# Altium schematic sheet Cpcis_connectors_P1_P2_P3.SchDoc: STM32 System Board
size 420 x 297 mm; CheckedBy: P. Kulik, G. Daniluk; CompanyName: Creotech Instruments SA; DrawnBy: G.Kasprowicz; DocumentNumber: 5; SheetNumber: 5; CreateDate: 1.10.2019; CheckedDate: 10.11.2019; Title2: CPCIS Connectors P1-P3; Designer: G.Kasprowicz; DocumentName: AFPGA_power.SchDoc; ModifiedDate: -; Rule: PcbType=ProtelPcb
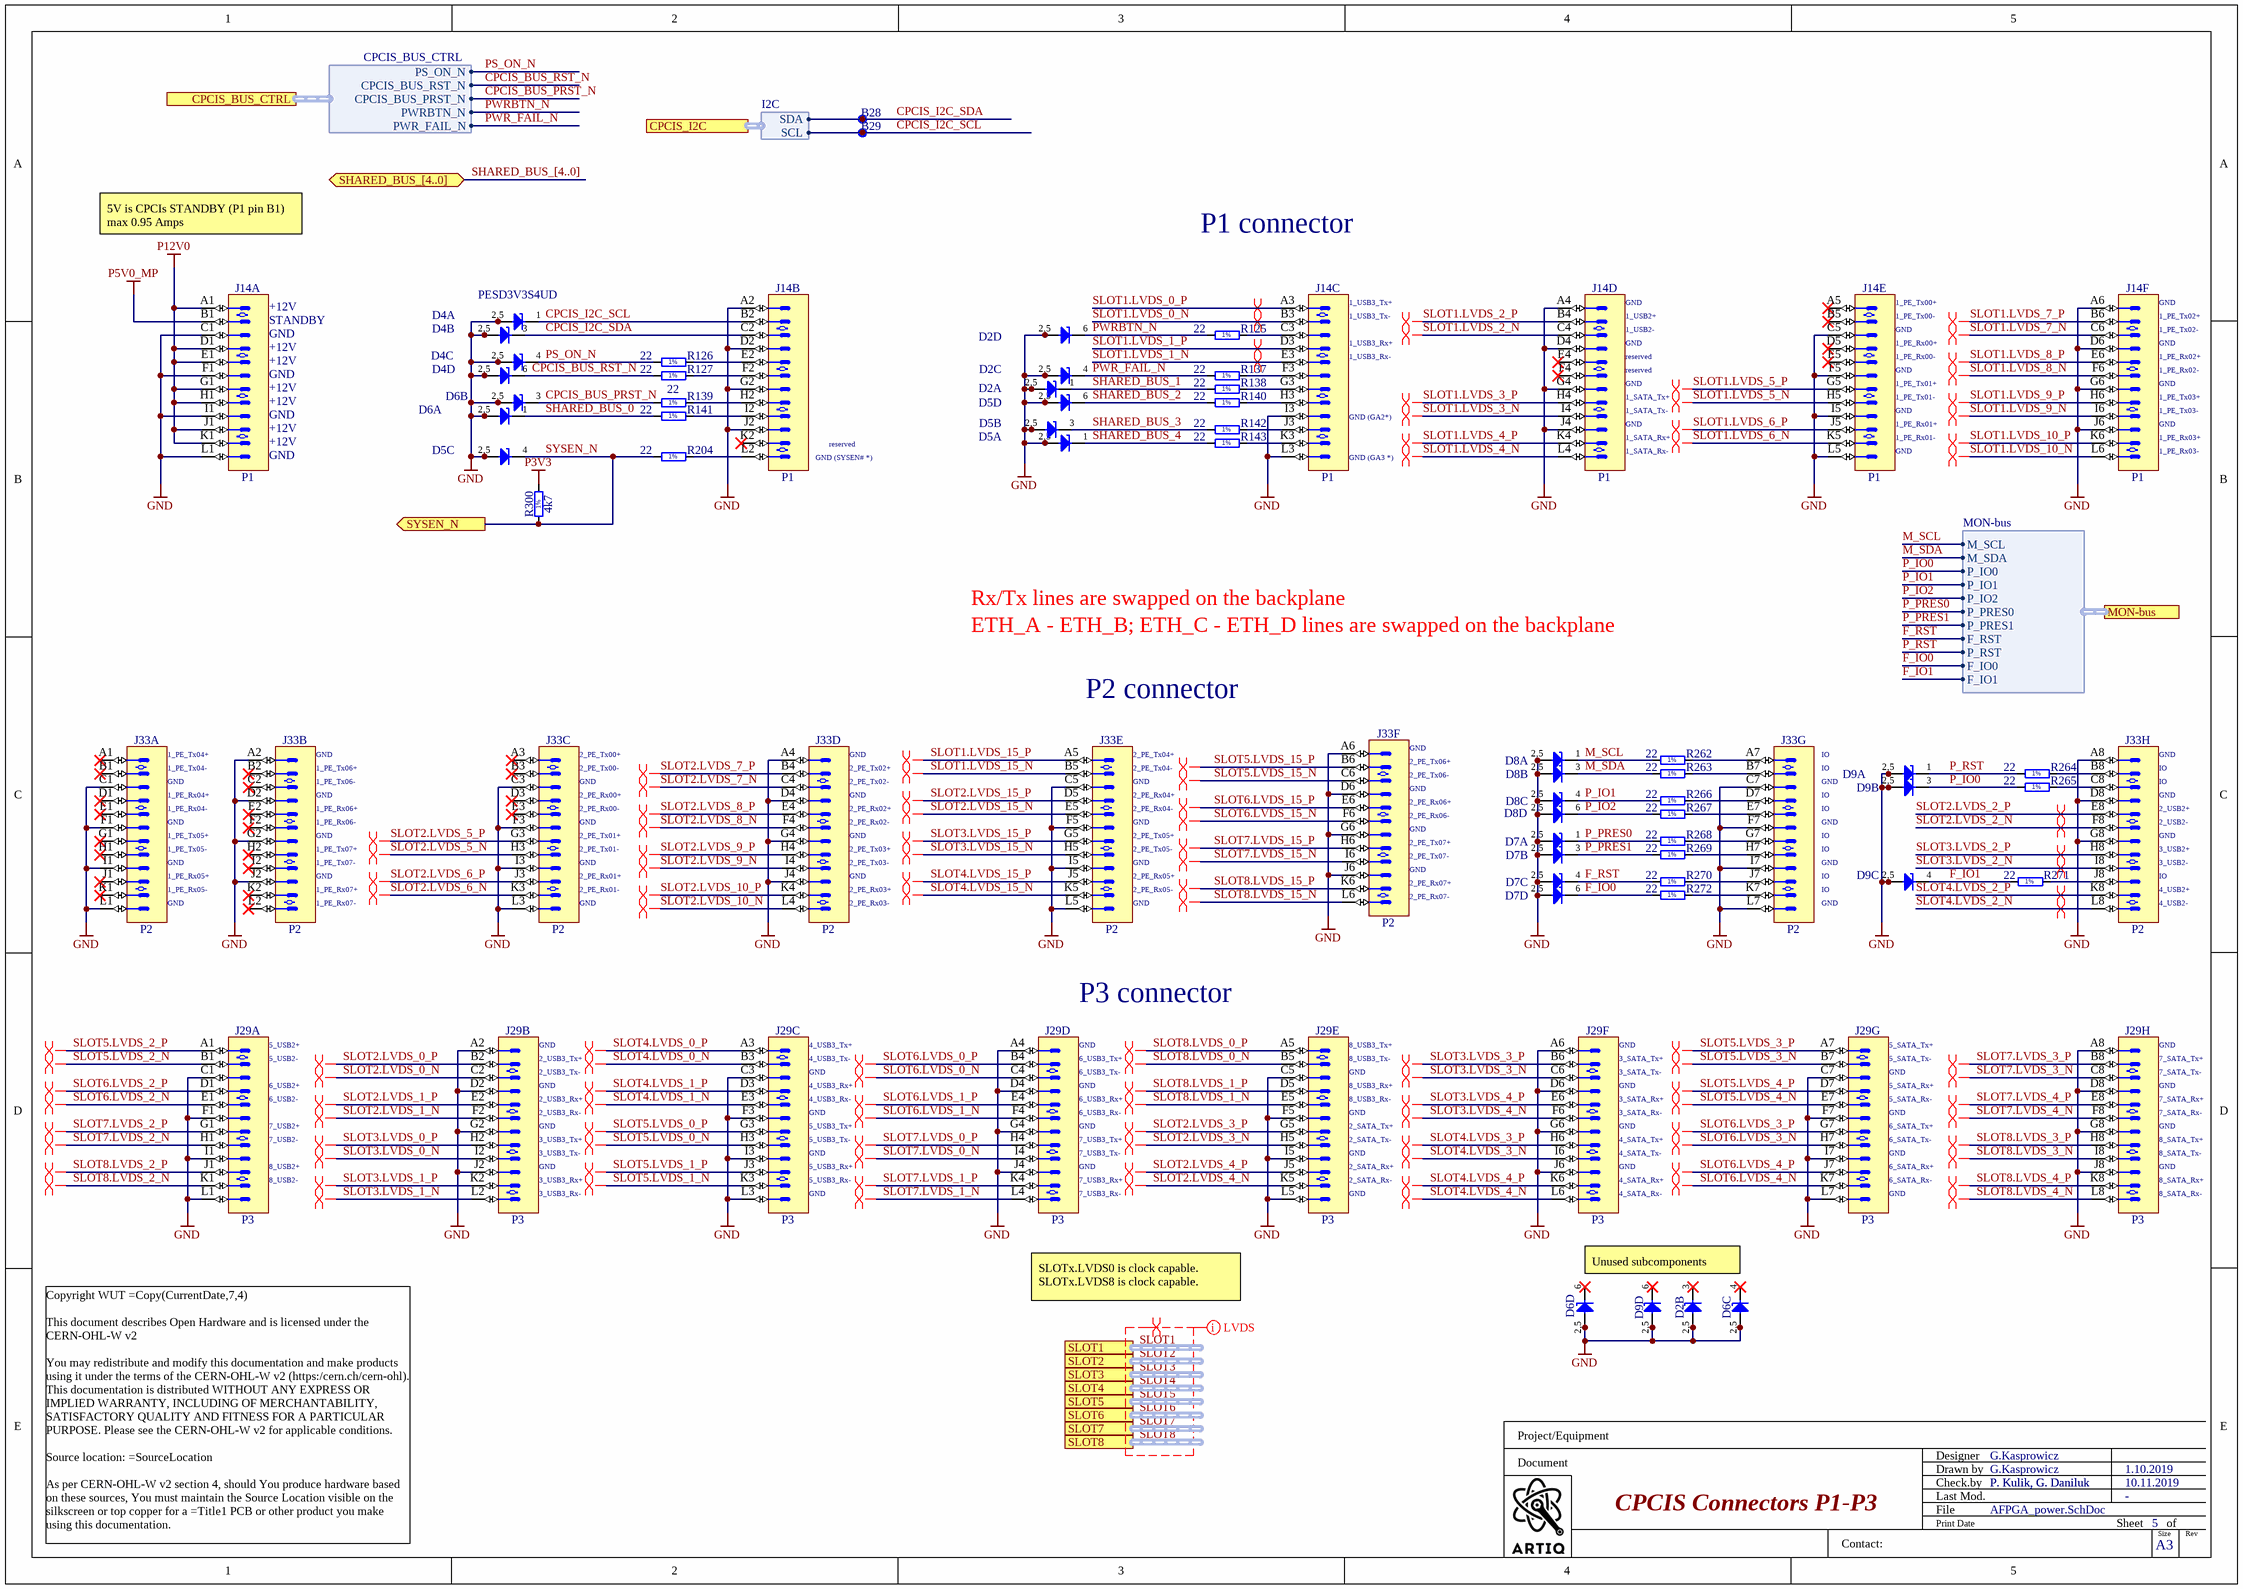
[diagram p0: Cpcis_connectors_P1_P2_P3.SchDoc]

## Parts
B28  SMD Pad  [C100]  (value not drawn)
B29  SMD Pad  [C100]  (value not drawn)
D2  PESD3V3S4UD  [SOT95P280X110-6N]  (value not drawn)  (parts A,B,C,D of 4)
D4  PESD3V3S4UD  [SOT95P280X110-6N]  (value not drawn)  (parts A,B,C,D of 4)
D5  PESD3V3S4UD  [SOT95P280X110-6N]  (value not drawn)  (parts A,B,C,D of 4)
D6  PESD3V3S4UD  [SOT95P280X110-6N]  (value not drawn)  (parts A,B,C,D of 4)
D7  PESD3V3S4UD  [SOT95P280X110-6N]  (value not drawn)  (parts A,B,C,D of 4)
D8  PESD3V3S4UD  [SOT95P280X110-6N]  (value not drawn)  (parts A,B,C,D of 4)
D9  PESD3V3S4UD  [SOT95P280X110-6N]  (value not drawn)  (parts A,B,C,D of 4)
J14  P1  [AMPHENOL_10052825-101LF]  (parts A,B,C,D,E,F of 6)
J29  P3  [AMPHENOL_10052837-101LF]  (parts A,B,C,D,E,F,G,H of 8)
J33  P2  [AMPHENOL_10052837-101LF]  (parts A,B,C,D,E,F,G,H of 8)
R125  22  [RESC1005X40N]
R126  22  [RESC1005X40N]
R127  22  [RESC1005X40N]
R137  22  [RESC1005X40N]
R138  22  [RESC1005X40N]
R139  22  [RESC1005X40N]
R140  22  [RESC1005X40N]
R141  22  [RESC1005X40N]
R142  22  [RESC1005X40N]
R143  22  [RESC1005X40N]
R204  22  [RESC1005X40N]
R262  22  [RESC1005X40N]
R263  22  [RESC1005X40N]
R264  22  [RESC1005X40N]
R265  22  [RESC1005X40N]
R266  22  [RESC1005X40N]
R267  22  [RESC1005X40N]
R268  22  [RESC1005X40N]
R269  22  [RESC1005X40N]
R270  22  [RESC1005X40N]
R271  22  [RESC1005X40N]
R272  22  [RESC1005X40N]
R300  4k7  [RESC1005X40N]

## Ports
CPCIS_BUS_CTRL (harness CPCIS_BUS_CTRL), CPCIS_I2C (harness I2C), MON-bus (harness MON-bus), SHARED_BUS_[4..0] (bidir), SLOT1 (harness SLOT), SLOT2 (harness SLOT), SLOT3 (harness SLOT), SLOT4 (harness SLOT), SLOT5 (harness SLOT), SLOT6 (harness SLOT), SLOT7 (harness SLOT), SLOT8 (harness SLOT), SYSEN_N (out)

## Harnesses
CPCIS_BUS_CTRL: PS_ON_N, CPCIS_BUS_RST_N, CPCIS_BUS_PRST_N, PWRBTN_N, PWR_FAIL_N
MON-bus: M_SCL, M_SDA, P_IO0, P_IO1, P_IO2, P_PRES0, P_PRES1, F_RST, P_RST, F_IO0, F_IO1
I2C: SDA, SCL

## Nets
GND: D2.2(A) D2.5(A) D4.2(A) D4.5(A) D5.2(A) D5.5(A) D6.2(A) D6.5(A) D7.2(A) D7.5(A) D8.2(A) D8.5(A) D9.2(A) D9.5(A) J14.A2 J14.A4 J14.A6 J14.C1 J14.C5 J14.D2 J14.D4 J14.D6 J14.F1 J14.F5 J14.G2 J14.G4 J14.G6 J14.I1 J14.I3 J14.I5 J14.J2 J14.J4 J14.J6 J14.L1 J14.L3 J14.L5 J29.A2 J29.A4 J29.A6 J29.A8 J29.C1 J29.C3 J29.C5 J29.C7 J29.D2 J29.D4 J29.D6 J29.D8 J29.F1 J29.F3 J29.F5 J29.F7 J29.G2 J29.G4 J29.G6 J29.G8 J29.I1 J29.I3 J29.I5 J29.I7 J29.J2 J29.J4 J29.J6 J29.J8 J29.L1 J29.L3 J29.L5 J29.L7 J33.A2 J33.A4 J33.A6 J33.A8 J33.C1 J33.C3 J33.C5 J33.C7 J33.D2 J33.D4 J33.D6 J33.D8 J33.F1 J33.F3 J33.F5 J33.F7 J33.G2 J33.G4 J33.G6 J33.G8 J33.I1 J33.I3 J33.I5 J33.I7 J33.J2 J33.J4 J33.J6 J33.L1 J33.L3 J33.L5 J33.L7
P3V3: R300.2
P5V0_MP: J14.B1
P12V0: J14.A1 J14.D1 J14.E1 J14.G1 J14.H1 J14.J1 J14.K1
CPCIS_BUS_PRST_N: D6.3(C) R139.1 ; port CPCIS_BUS_CTRL.CPCIS_BUS_PRST_N
CPCIS_BUS_RST_N: D4.6(C) R127.1 ; port CPCIS_BUS_CTRL.CPCIS_BUS_RST_N
CPCIS_I2C_SCL: B29.1 D4.1(C) J14.B2 ; port CPCIS_I2C.SCL
CPCIS_I2C_SDA: B28.1 D4.3(C) J14.C2 ; port CPCIS_I2C.SDA
F_IO0: D7.6(C) R272.1 ; port MON-bus.F_IO0
F_IO1: D9.4(C) R271.1 ; port MON-bus.F_IO1
F_RST: D7.4(C) R270.1 ; port MON-bus.F_RST
M_SCL: D8.1(C) R262.1 ; port MON-bus.M_SCL
M_SDA: D8.3(C) R263.1 ; port MON-bus.M_SDA
P_IO0: D9.3(C) R265.1 ; port MON-bus.P_IO0
P_IO1: D8.4(C) R266.1 ; port MON-bus.P_IO1
P_IO2: D8.6(C) R267.1 ; port MON-bus.P_IO2
P_PRES0: D7.1(C) R268.1 ; port MON-bus.P_PRES0
P_PRES1: D7.3(C) R269.1 ; port MON-bus.P_PRES1
P_RST: D9.1(C) R264.1 ; port MON-bus.P_RST
PS_ON_N: D4.4(C) R126.1 ; port CPCIS_BUS_CTRL.PS_ON_N
PWR_FAIL_N: D2.4(C) R137.1 ; port CPCIS_BUS_CTRL.PWR_FAIL_N
PWRBTN_N: D2.6(C) R125.1 ; port CPCIS_BUS_CTRL.PWRBTN_N
SHARED_BUS_0: D6.1(C) R141.1
SHARED_BUS_1: D2.1(C) R138.1
SHARED_BUS_2: D5.6(C) R140.1
SHARED_BUS_3: D5.3(C) R142.1
SHARED_BUS_4: D5.1(C) R143.1
SLOT1.LVDS_0_N: J14.B3
SLOT1.LVDS_0_P: J14.A3
SLOT1.LVDS_1_N: J14.E3
SLOT1.LVDS_1_P: J14.D3
SLOT1.LVDS_2_N: J14.C4
SLOT1.LVDS_2_P: J14.B4
SLOT1.LVDS_3_N: J14.I4
SLOT1.LVDS_3_P: J14.H4
SLOT1.LVDS_4_N: J14.L4
SLOT1.LVDS_4_P: J14.K4
SLOT1.LVDS_5_N: J14.H5
SLOT1.LVDS_5_P: J14.G5
SLOT1.LVDS_6_N: J14.K5
SLOT1.LVDS_6_P: J14.J5
SLOT1.LVDS_7_N: J14.C6
SLOT1.LVDS_7_P: J14.B6
SLOT1.LVDS_8_N: J14.F6
SLOT1.LVDS_8_P: J14.E6
SLOT1.LVDS_9_N: J14.I6
SLOT1.LVDS_9_P: J14.H6
SLOT1.LVDS_10_N: J14.L6
SLOT1.LVDS_10_P: J14.K6
SLOT1.LVDS_15_N: J33.B5
SLOT1.LVDS_15_P: J33.A5
SLOT2.LVDS_0_N: J29.C2
SLOT2.LVDS_0_P: J29.B2
SLOT2.LVDS_1_N: J29.F2
SLOT2.LVDS_1_P: J29.E2
SLOT2.LVDS_2_N: J33.F8
SLOT2.LVDS_2_P: J33.E8
SLOT2.LVDS_3_N: J29.H5
SLOT2.LVDS_3_P: J29.G5
SLOT2.LVDS_4_N: J29.K5
SLOT2.LVDS_4_P: J29.J5
SLOT2.LVDS_5_N: J33.H3
SLOT2.LVDS_5_P: J33.G3
SLOT2.LVDS_6_N: J33.K3
SLOT2.LVDS_6_P: J33.J3
SLOT2.LVDS_7_N: J33.C4
SLOT2.LVDS_7_P: J33.B4
SLOT2.LVDS_8_N: J33.F4
SLOT2.LVDS_8_P: J33.E4
SLOT2.LVDS_9_N: J33.I4
SLOT2.LVDS_9_P: J33.H4
SLOT2.LVDS_10_N: J33.L4
SLOT2.LVDS_10_P: J33.K4
SLOT2.LVDS_15_N: J33.E5
SLOT2.LVDS_15_P: J33.D5
SLOT3.LVDS_0_N: J29.I2
SLOT3.LVDS_0_P: J29.H2
SLOT3.LVDS_1_N: J29.L2
SLOT3.LVDS_1_P: J29.K2
SLOT3.LVDS_2_N: J33.I8
SLOT3.LVDS_2_P: J33.H8
SLOT3.LVDS_3_N: J29.C6
SLOT3.LVDS_3_P: J29.B6
SLOT3.LVDS_4_N: J29.F6
SLOT3.LVDS_4_P: J29.E6
SLOT3.LVDS_15_N: J33.H5
SLOT3.LVDS_15_P: J33.G5
SLOT4.LVDS_0_N: J29.B3
SLOT4.LVDS_0_P: J29.A3
SLOT4.LVDS_1_N: J29.E3
SLOT4.LVDS_1_P: J29.D3
SLOT4.LVDS_2_N: J33.L8
SLOT4.LVDS_2_P: J33.K8
SLOT4.LVDS_3_N: J29.I6
SLOT4.LVDS_3_P: J29.H6
SLOT4.LVDS_4_N: J29.L6
SLOT4.LVDS_4_P: J29.K6
SLOT4.LVDS_15_N: J33.K5
SLOT4.LVDS_15_P: J33.J5
SLOT5.LVDS_0_N: J29.H3
SLOT5.LVDS_0_P: J29.G3
SLOT5.LVDS_1_N: J29.K3
SLOT5.LVDS_1_P: J29.J3
SLOT5.LVDS_2_N: J29.B1
SLOT5.LVDS_2_P: J29.A1
SLOT5.LVDS_3_N: J29.B7
SLOT5.LVDS_3_P: J29.A7
SLOT5.LVDS_4_N: J29.E7
SLOT5.LVDS_4_P: J29.D7
SLOT5.LVDS_15_N: J33.C6
SLOT5.LVDS_15_P: J33.B6
SLOT6.LVDS_0_N: J29.C4
SLOT6.LVDS_0_P: J29.B4
SLOT6.LVDS_1_N: J29.F4
SLOT6.LVDS_1_P: J29.E4
SLOT6.LVDS_2_N: J29.E1
SLOT6.LVDS_2_P: J29.D1
SLOT6.LVDS_3_N: J29.H7
SLOT6.LVDS_3_P: J29.G7
SLOT6.LVDS_4_N: J29.K7
SLOT6.LVDS_4_P: J29.J7
SLOT6.LVDS_15_N: J33.F6
SLOT6.LVDS_15_P: J33.E6
SLOT7.LVDS_0_N: J29.I4
SLOT7.LVDS_0_P: J29.H4
SLOT7.LVDS_1_N: J29.L4
SLOT7.LVDS_1_P: J29.K4
SLOT7.LVDS_2_N: J29.H1
SLOT7.LVDS_2_P: J29.G1
SLOT7.LVDS_3_N: J29.C8
SLOT7.LVDS_3_P: J29.B8
SLOT7.LVDS_4_N: J29.F8
SLOT7.LVDS_4_P: J29.E8
SLOT7.LVDS_15_N: J33.I6
SLOT7.LVDS_15_P: J33.H6
SLOT8.LVDS_0_N: J29.B5
SLOT8.LVDS_0_P: J29.A5
SLOT8.LVDS_1_N: J29.E5
SLOT8.LVDS_1_P: J29.D5
SLOT8.LVDS_2_N: J29.K1
SLOT8.LVDS_2_P: J29.J1
SLOT8.LVDS_3_N: J29.I8
SLOT8.LVDS_3_P: J29.H8
SLOT8.LVDS_4_N: J29.L8
SLOT8.LVDS_4_P: J29.K8
SLOT8.LVDS_15_N: J33.L6
SLOT8.LVDS_15_P: J33.K6
SYSEN_N: D5.4(C) R204.1 R300.1 ; port SYSEN_N
NetJ14_C3: J14.C3 R125.2
NetJ14_E2: J14.E2 R126.2
NetJ14_F2: J14.F2 R127.2
NetJ14_F3: J14.F3 R137.2
NetJ14_G3: J14.G3 R138.2
NetJ14_H2: J14.H2 R139.2
NetJ14_H3: J14.H3 R140.2
NetJ14_I2: J14.I2 R141.2
NetJ14_J3: J14.J3 R142.2
NetJ14_K3: J14.K3 R143.2
NetJ14_L2: J14.L2 R204.2
NetJ33_A7: J33.A7 R262.2
NetJ33_B7: J33.B7 R263.2
NetJ33_B8: J33.B8 R264.2
NetJ33_C8: J33.C8 R265.2
NetJ33_D7: J33.D7 R266.2
NetJ33_E7: J33.E7 R267.2
NetJ33_G7: J33.G7 R268.2
NetJ33_H7: J33.H7 R269.2
NetJ33_J7: J33.J7 R270.2
NetJ33_J8: J33.J8 R271.2
NetJ33_K7: J33.K7 R272.2

Not connected (* = marked no-connect by the designer): D2 3(C)*; D6 4(C)* 6(C)*; D9 6(C)*; J14 A5* B5* D5* E4* E5* F4* K2*; J33 A1* A3* B1* B2* B3* C2* D1* D3* E1* E2* E3* F2* G1* H1* H2* I2* J1* K1* K2* L2*

## Buses and harness runs
bus SHARED_BUS_[4..0] = port SHARED_BUS_[4..0]
harness SLOT1 = port SLOT1
harness SLOT2 = port SLOT2
harness SLOT3 = port SLOT3
harness SLOT4 = port SLOT4
harness SLOT5 = port SLOT5
harness SLOT6 = port SLOT6
harness SLOT7 = port SLOT7
harness SLOT8 = port SLOT8

## Layout directives
differential pair: SLOT1, SLOT1.LVDS_0_N, SLOT1.LVDS_0_P, SLOT1.LVDS_1_N, SLOT1.LVDS_1_P, SLOT1.LVDS_2_N, SLOT1.LVDS_2_P, SLOT1.LVDS_3_N, SLOT1.LVDS_3_P, SLOT1.LVDS_4_N, SLOT1.LVDS_4_P, SLOT1.LVDS_5_N, SLOT1.LVDS_5_P, SLOT1.LVDS_6_N, SLOT1.LVDS_6_P, SLOT1.LVDS_7_N, SLOT1.LVDS_7_P, SLOT1.LVDS_8_N, SLOT1.LVDS_8_P, SLOT1.LVDS_9_N, SLOT1.LVDS_9_P, SLOT1.LVDS_10_N, SLOT1.LVDS_10_P, SLOT1.LVDS_15_N, SLOT1.LVDS_15_P, SLOT2, SLOT2.LVDS_0_N, SLOT2.LVDS_0_P, SLOT2.LVDS_1_N, SLOT2.LVDS_1_P, SLOT2.LVDS_2_N, SLOT2.LVDS_2_P, SLOT2.LVDS_3_N, SLOT2.LVDS_3_P, SLOT2.LVDS_4_N, SLOT2.LVDS_4_P, SLOT2.LVDS_5_N, SLOT2.LVDS_5_P, SLOT2.LVDS_6_N, SLOT2.LVDS_6_P, SLOT2.LVDS_7_N, SLOT2.LVDS_7_P, SLOT2.LVDS_8_N, SLOT2.LVDS_8_P, SLOT2.LVDS_9_N, SLOT2.LVDS_9_P, SLOT2.LVDS_10_N, SLOT2.LVDS_10_P, SLOT2.LVDS_15_N, SLOT2.LVDS_15_P, SLOT3, SLOT3.LVDS_0_N, SLOT3.LVDS_0_P, SLOT3.LVDS_1_N, SLOT3.LVDS_1_P, SLOT3.LVDS_2_N, SLOT3.LVDS_2_P, SLOT3.LVDS_3_N, SLOT3.LVDS_3_P, SLOT3.LVDS_4_N, SLOT3.LVDS_4_P, SLOT3.LVDS_15_N, SLOT3.LVDS_15_P, SLOT4, SLOT4.LVDS_0_N, SLOT4.LVDS_0_P, SLOT4.LVDS_1_N, SLOT4.LVDS_1_P, SLOT4.LVDS_2_N, SLOT4.LVDS_2_P, SLOT4.LVDS_3_N, SLOT4.LVDS_3_P, SLOT4.LVDS_4_N, SLOT4.LVDS_4_P, SLOT4.LVDS_15_N, SLOT4.LVDS_15_P, SLOT5, SLOT5.LVDS_0_N, SLOT5.LVDS_0_P, SLOT5.LVDS_1_N, SLOT5.LVDS_1_P, SLOT5.LVDS_2_N, SLOT5.LVDS_2_P, SLOT5.LVDS_3_N, SLOT5.LVDS_3_P, SLOT5.LVDS_4_N, SLOT5.LVDS_4_P, SLOT5.LVDS_15_N, SLOT5.LVDS_15_P, SLOT6, SLOT6.LVDS_0_N, SLOT6.LVDS_0_P, SLOT6.LVDS_1_N, SLOT6.LVDS_1_P, SLOT6.LVDS_2_N, SLOT6.LVDS_2_P, SLOT6.LVDS_3_N, SLOT6.LVDS_3_P, SLOT6.LVDS_4_N, SLOT6.LVDS_4_P, SLOT6.LVDS_15_N, SLOT6.LVDS_15_P, SLOT7, SLOT7.LVDS_0_N, SLOT7.LVDS_0_P, SLOT7.LVDS_1_N, SLOT7.LVDS_1_P, SLOT7.LVDS_2_N, SLOT7.LVDS_2_P, SLOT7.LVDS_3_N, SLOT7.LVDS_3_P, SLOT7.LVDS_4_N, SLOT7.LVDS_4_P, SLOT7.LVDS_15_N, SLOT7.LVDS_15_P, SLOT8, SLOT8.LVDS_0_N, SLOT8.LVDS_0_P, SLOT8.LVDS_1_N, SLOT8.LVDS_1_P, SLOT8.LVDS_2_N, SLOT8.LVDS_2_P, SLOT8.LVDS_3_N, SLOT8.LVDS_3_P, SLOT8.LVDS_4_N, SLOT8.LVDS_4_P, SLOT8.LVDS_15_N, SLOT8.LVDS_15_P
net class LVDS: SLOT1, SLOT2, SLOT3, SLOT4, SLOT5, SLOT6, SLOT7, SLOT8

## Notes on the sheet
- 5V is CPCIs STANDBY (P1 pin B1)
  max 0.95 Amps
- P1 connector
- (near J14) +12V
- (near J14) STANDBY
- (near J14) 1_USB3_Tx+
- (near J14) 1_USB3_Tx-
- (near J14) 1_USB2+
- (near J14) GND
- (near J14) 1_PE_Tx00+
- (near J14) 1_PE_Tx00-
- (near J14) 1_PE_Tx02+
- (near J14) 1_USB3_Rx+
- (near J14) 1_USB3_Rx-
- (near J14) 1_USB2-
- (near J14) 1_SATA_Tx+
- (near J14) reserved
- (near J14) 1_PE_Tx01+
- (near J14) 1_PE_Tx01-
- (near J14) 1_PE_Rx00+
- (near J14) 1_PE_Rx00-
- (near J14) 1_PE_Tx02-
- (near J14) 1_PE_Rx02+
- (near J14) 1_PE_Rx02-
- (near J14) 1_PE_Tx03+
- (near J14) GND (SYSEN# *)
- reserved
- (near J14) GND (GA2*)
- (near J14) GND (GA3 *)
- (near J14) 1_SATA_Tx-
- (near J14) 1_SATA_Rx+
- (near J14) 1_SATA_Rx-
- (near J14) 1_PE_Rx01+
- (near J14) 1_PE_Rx01-
- (near J14) 1_PE_Tx03-
- (near J14) 1_PE_Rx03+
- (near J14) 1_PE_Rx03-
- ETH_A - ETH_B; ETH_C - ETH_D lines are swapped on the backplane
- Rx/Tx lines are swapped on the backplane
- P2 connector
- (near J33) 1_PE_Tx04+
- (near J33) 1_PE_Tx04-
- (near J33) GND
- (near J33) 1_PE_Rx04+
- (near J33) 1_PE_Tx06+
- (near J33) 1_PE_Tx06-
- (near J33) 2_PE_Tx00+
- (near J33) 2_PE_Tx00-
- (near J33) 2_PE_Rx00+
- (near J33) 2_PE_Tx02+
- (near J33) 2_PE_Tx02-
- (near J33) 2_PE_Tx04+
- (near J33) 2_PE_Tx04-
- (near J33) 2_PE_Rx04+
- (near J33) 2_PE_Tx06+
- (near J33) 2_PE_Tx06-
- (near J33) 2_PE_Rx06+
- (near J33) IO
- IO
- GND
- (near J33) 1_PE_Rx04-
- (near J33) 1_PE_Tx05+
- (near J33) 1_PE_Tx05-
- (near J33) 1_PE_Rx06+
- (near J33) 1_PE_Rx06-
- (near J33) 1_PE_Tx07+
- (near J33) 1_PE_Tx07-
- (near J33) 2_PE_Tx01+
- (near J33) 2_PE_Tx01-
- (near J33) 2_PE_Rx00-
- (near J33) 2_PE_Rx02+
- (near J33) 2_PE_Rx02-
- (near J33) 2_PE_Tx03+
- (near J33) 2_PE_Tx03-
- (near J33) 2_PE_Rx04-
- (near J33) 2_PE_Tx05+
- (near J33) 2_PE_Tx05-
- (near J33) 2_PE_Rx06-
- (near J33) 2_PE_Tx07+
- (near J33) 2_PE_Tx07-
- (near J33) 2_USB2+
- (near J33) 2_USB2-
- (near J33) 3_USB2+
- (near J33) 3_USB2-
- (near J33) 1_PE_Rx05+
- (near J33) 1_PE_Rx05-
- (near J33) 1_PE_Rx07+
- (near J33) 1_PE_Rx07-
- (near J33) 2_PE_Rx01+
- (near J33) 2_PE_Rx01-
- (near J33) 2_PE_Rx03+
- (near J33) 2_PE_Rx03-
- (near J33) 2_PE_Rx05+
- (near J33) 2_PE_Rx05-
- (near J33) 2_PE_Rx07+
- (near J33) 2_PE_Rx07-
- (near J33) 4_USB2+
- (near J33) 4_USB2-
- (near J29) 5_USB2+
- (near J29) 5_USB2-
- (near J29) GND
- (near J29) 2_USB3_Tx+
- (near J29) 2_USB3_Tx-
- (near J29) 4_USB3_Tx+
- (near J29) 4_USB3_Tx-
- P3 connector
- (near J29) 6_USB3_Tx+
- (near J29) 6_USB3_Tx-
- (near J29) 8_USB3_Tx+
- (near J29) 8_USB3_Tx-
- (near J29) 3_SATA_Tx+
- (near J29) 3_SATA_Tx-
- (near J29) 5_SATA_Tx+
- (near J29) 5_SATA_Tx-
- (near J29) 7_SATA_Tx+
- (near J29) 7_SATA_Tx-
- (near J29) 6_USB2+
- (near J29) 6_USB2-
- (near J29) 7_USB2+
- (near J29) 2_USB3_Rx+
- (near J29) 2_USB3_Rx-
- (near J29) 4_USB3_Rx+
- (near J29) 4_USB3_Rx-
- (near J29) 5_USB3_Tx+
- (near J29) 6_USB3_Rx+
- (near J29) 6_USB3_Rx-
- (near J29) 8_USB3_Rx+
- (near J29) 8_USB3_Rx-
- (near J29) 2_SATA_Tx+
- (near J29) 3_SATA_Rx+
- (near J29) 3_SATA_Rx-
- (near J29) 5_SATA_Rx+
- (near J29) 5_SATA_Rx-
- (near J29) 6_SATA_Tx+
- (near J29) 7_SATA_Rx+
- (near J29) 7_SATA_Rx-
- (near J29) 7_USB2-
- (near J29) 8_USB2+
- (near J29) 8_USB2-
- (near J29) 3_USB3_Tx+
- (near J29) 3_USB3_Tx-
- (near J29) 3_USB3_Rx+
- (near J29) 3_USB3_Rx-
- (near J29) 5_USB3_Tx-
- (near J29) 5_USB3_Rx+
- (near J29) 5_USB3_Rx-
- (near J29) 7_USB3_Tx+
- (near J29) 7_USB3_Tx-
- (near J29) 7_USB3_Rx+
- (near J29) 7_USB3_Rx-
- (near J29) 2_SATA_Tx-
- (near J29) 2_SATA_Rx+
- (near J29) 2_SATA_Rx-
- (near J29) 4_SATA_Tx+
- (near J29) 4_SATA_Tx-
- (near J29) 4_SATA_Rx+
- (near J29) 4_SATA_Rx-
- (near J29) 6_SATA_Tx-
- (near J29) 6_SATA_Rx+
- (near J29) 6_SATA_Rx-
- (near J29) 8_SATA_Tx+
- (near J29) 8_SATA_Tx-
- (near J29) 8_SATA_Rx+
- (near J29) 8_SATA_Rx-
- (near D6) Unused subcomponents
- SLOTx.LVDS0 is clock capable.
  SLOTx.LVDS8 is clock capable.
- Project/Equipment
- Document
- Designer
- Drawn by
- Check.by
- Copyright WUT =Copy(CurrentDate,7,4)
  This document describes Open Hardware and is licensed under the CERN-OHL-W v2
  You may redistribute and modify this documentation and make products using it under the terms of the CERN-OHL-W v2 (https:/cern.ch/cern-ohl). This documentation is distributed WITHOUT ANY EXPRESS OR IMPLIED WARRANTY, INCLUDING OF MERCHANTABILITY, SATISFACTORY QUALITY AND FITNESS FOR A PARTICULAR PURPOSE. Please see the CERN-OHL-W v2 for applicable conditions.
  Source location: =SourceLocation
  As per CERN-OHL-W v2 section 4, should You produce hardware based on these sources, You must maintain the Source Location visible on the silkscreen or top copper for a =Title1 PCB or other product you make using this documentation.
- Contact:
- File
- Last Mod.
- Print Date
- Sheet
- Size
- A3
- of
- Rev
- (in symbol PESD3V3S4UD, part A) 2,5
- (in symbol PESD3V3S4UD, part B) 2,5
- (in symbol PESD3V3S4UD, part C) 2,5
- (in symbol PESD3V3S4UD, part D) 2,5
- (in symbol R0402_4K7_1%_0.0625W_100PPM) 1%
- (in symbol R0402_22R_1%_0.0625W_100PPM) 1%

## Library data of the parts
B28 B29 = SMD_PAD_D1MM: Through Hole Pad; Part Description: 1mm Diameter SMD Pad; Mounted: No; Part Number: SMD_PAD_D1MM; Component Kind: Standard (No BOM); Component Type: Standard (No BOM); Pin Count: 1; Family: SMD Pad; Socket: No; SMD: No; Sense: No; Status: None; ComponentHeight: 0mm; HelpURL: Undefined; Author: CERN DEM JLC; CreateDate: 10.10.2017; LatestRevisionDate: 10.10.2017; PackageDescription: 1mm Diameter SMD Pad
D2 D4-D9 = PESD3V3S4UD: Quad Common Anode ESD Protection Diodes (30kV); Manufacturer: NXP SEMICONDUCTORS; Voltage: 3V3; Power: 200W; PressFit: No; Bonding: No; Part Number: PESD3V3S4UD; Component Kind: Standard; Component Type: Standard; Device: PESD3V3S4UD; PackageDescription: SOT, 0.95mm Pitch; 6 Pin, 1.60mm W X 2.90mm L X 1.10mm H Body, IPC Medium Density; Part Description: Quad Common Anode ESD Protection Diodes (30kV); Manufacturer Part Number: PESD3V3S4UD; Pin Count: 6; Case: SOT23-6; Mounted: Yes; Socket: No; SMD: Yes; Sense: No; ComponentHeight: 1.1mm; HelpURL: \\cern.ch\dfs\Applications\Altium\Datasheets\PESD3V3S4UD.pdf; Author: CERN DEM MR; CreateDate: 08/02/2016; LatestRevisionDate: 16/01/2018
J14 = AMPHENOL_10052825-101LF: 72 Contacts Header, 6 Columns, 4 Pairs per Column; Part Description: 72 Contacts, 2mm Pitch, 6 Columns, 4 Pairs per Column, 4 Walls, Right Angle Header; Part Number: AMPHENOL_10052825-101LF; Component Kind: Standard; Component Type: Standard; Pin Count: 72; Family: AirMax VS; Mounted: Yes; Socket: No; SMD: No; PressFit: Yes; Sense: No; Status: None; Manufacturer: AMPHENOL; Manufacturer Part Number: 10052825-101LF; ComponentHeight: 15.35mm; HelpURL: \\cern.ch\dfs\Applications\Altium\Datasheets\AMPHENOL_10052825-101LF.pdf; ComponentLink1URL: \\cern.ch\dfs\Applications\Altium\Datasheets\AMPHENOL_10052825-101LF_Application.pdf; ComponentLink1Description: Application; Author: CERN DEM MR; CreateDate: 19/02/2018; LatestRevisionDate: 19/02/2018; Classname: Overlapping
J29 J33 = AMPHENOL_10052837-101LF: 96 Contacts Header, 8 Columns, 4 Pairs per Column; Part Description: 96 Contacts, 2mm Pitch, 8 Columns, 4 Pairs per Column, 2 Walls, Right Angle Header; Part Number: AMPHENOL_10052837-101LF; Component Kind: Standard; Component Type: Standard; Pin Count: 96; Family: AirMax VS; Mounted: Yes; Socket: No; SMD: No; PressFit: Yes; Sense: No; Status: None; Manufacturer: AMPHENOL; Manufacturer Part Number: 10052837-101LF; ComponentHeight: 15.35mm; HelpURL: \\cern.ch\dfs\Applications\Altium\Datasheets\AMPHENOL_10052837-101LF.pdf; ComponentLink1URL: \\cern.ch\dfs\Applications\Altium\Datasheets\AMPHENOL_10052837-101LF_Application.pdf; ComponentLink1Description: Application; Author: CERN DEM MR; CreateDate: 19/02/2018; LatestRevisionDate: 19/02/2018
R125-R127 R137-R143 R204 R262-R272 = R0402_22R_1%_0.0625W_100PPM: Resistor - 1%; Part Description: General Purpose Thick Film Chip Resistor; Manufacturer: GENERIC; Manufacturer1 Part Number: 232270672209L; TC: ±100ppm/°C; PressFit: No; Part Number: R0402_22R_1%_0.0625W_100PPM; Component Kind: Standard; Component Type: Standard; Pin Count: 2; Value: 22; Status: Not Recommended; Power: 0.0625W; Tolerance: ±1%; Manufacturer Part Number: R0402_22R_1%_0.0625W_100PPM; Case: 0402; Mounted: Yes; Socket: No; SMD: Yes; Manufacturer1 Example: YAGEO PHYCOMP; Manufacturer1 ComponentHeight: 0.4mm; HelpURL: \\cern.ch\dfs\Applications\Altium\Datasheets\R0402_Phycomp_RC0402.pdf; Author: CERN DEM JLC; CreateDate: 03.12.2007; LatestRevisionDate: 17.10.2012; Sense: No
R300 = R0402_4K7_1%_0.0625W_100PPM: Resistor - 1%; Part Description: General Purpose Thick Film Chip Resistor; Manufacturer: GENERIC; Manufacturer1 Part Number: 232270674702L; TC: ±100ppm/°C; PressFit: No; Part Number: R0402_4K7_1%_0.0625W_100PPM; Component Kind: Standard; Component Type: Standard; Pin Count: 2; Value: 4k7; Status: Not Recommended; Power: 0.0625W; Tolerance: ±1%; Manufacturer Part Number: R0402_4K7_1%_0.0625W_100PPM; Case: 0402; Mounted: Yes; Sense: No; Socket: No; SMD: Yes; Manufacturer1 Example: YAGEO PHYCOMP; Manufacturer1 ComponentHeight: 0.4mm; HelpURL: \\cern.ch\dfs\Applications\Altium\Datasheets\R0402_Phycomp_RC0402.pdf; Author: CERN DEM JLC; CreateDate: 03-Dec-07; LatestRevisionDate: 17-Oct-12